# EasyEDA Pro project 3SE_24_Power_Rune.eprj, board Armour
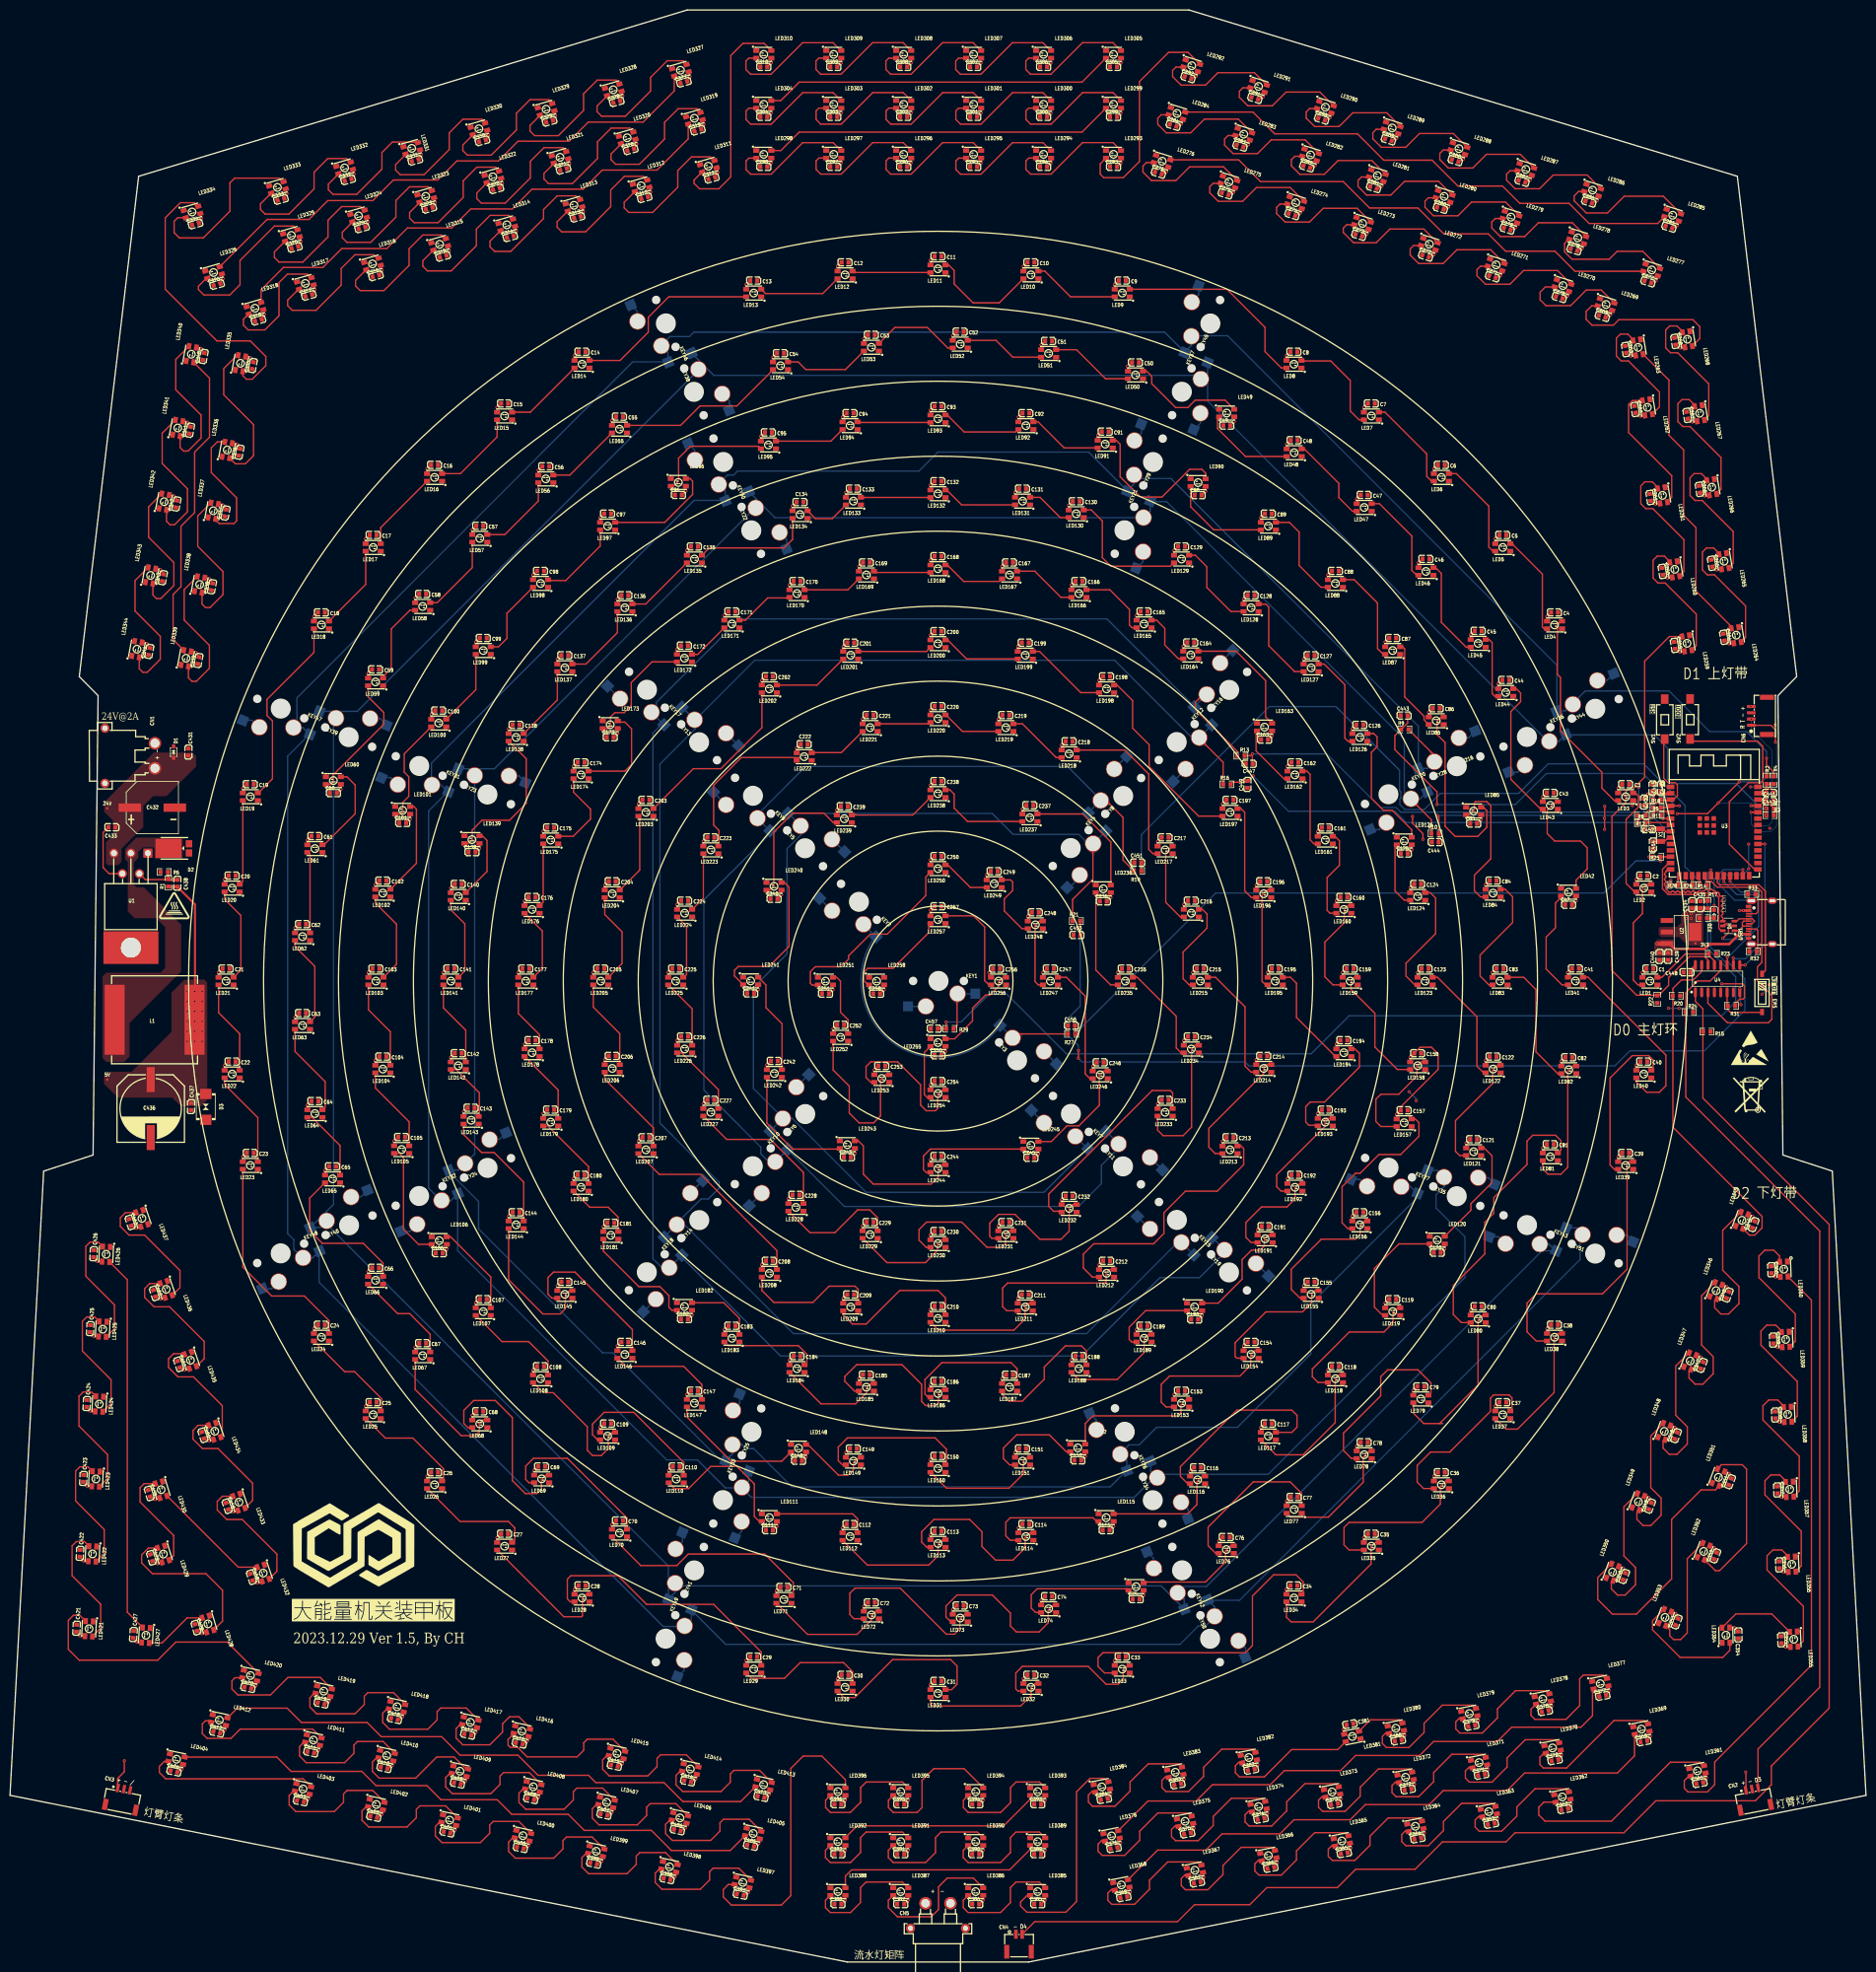
[diagram p11: board, top side]
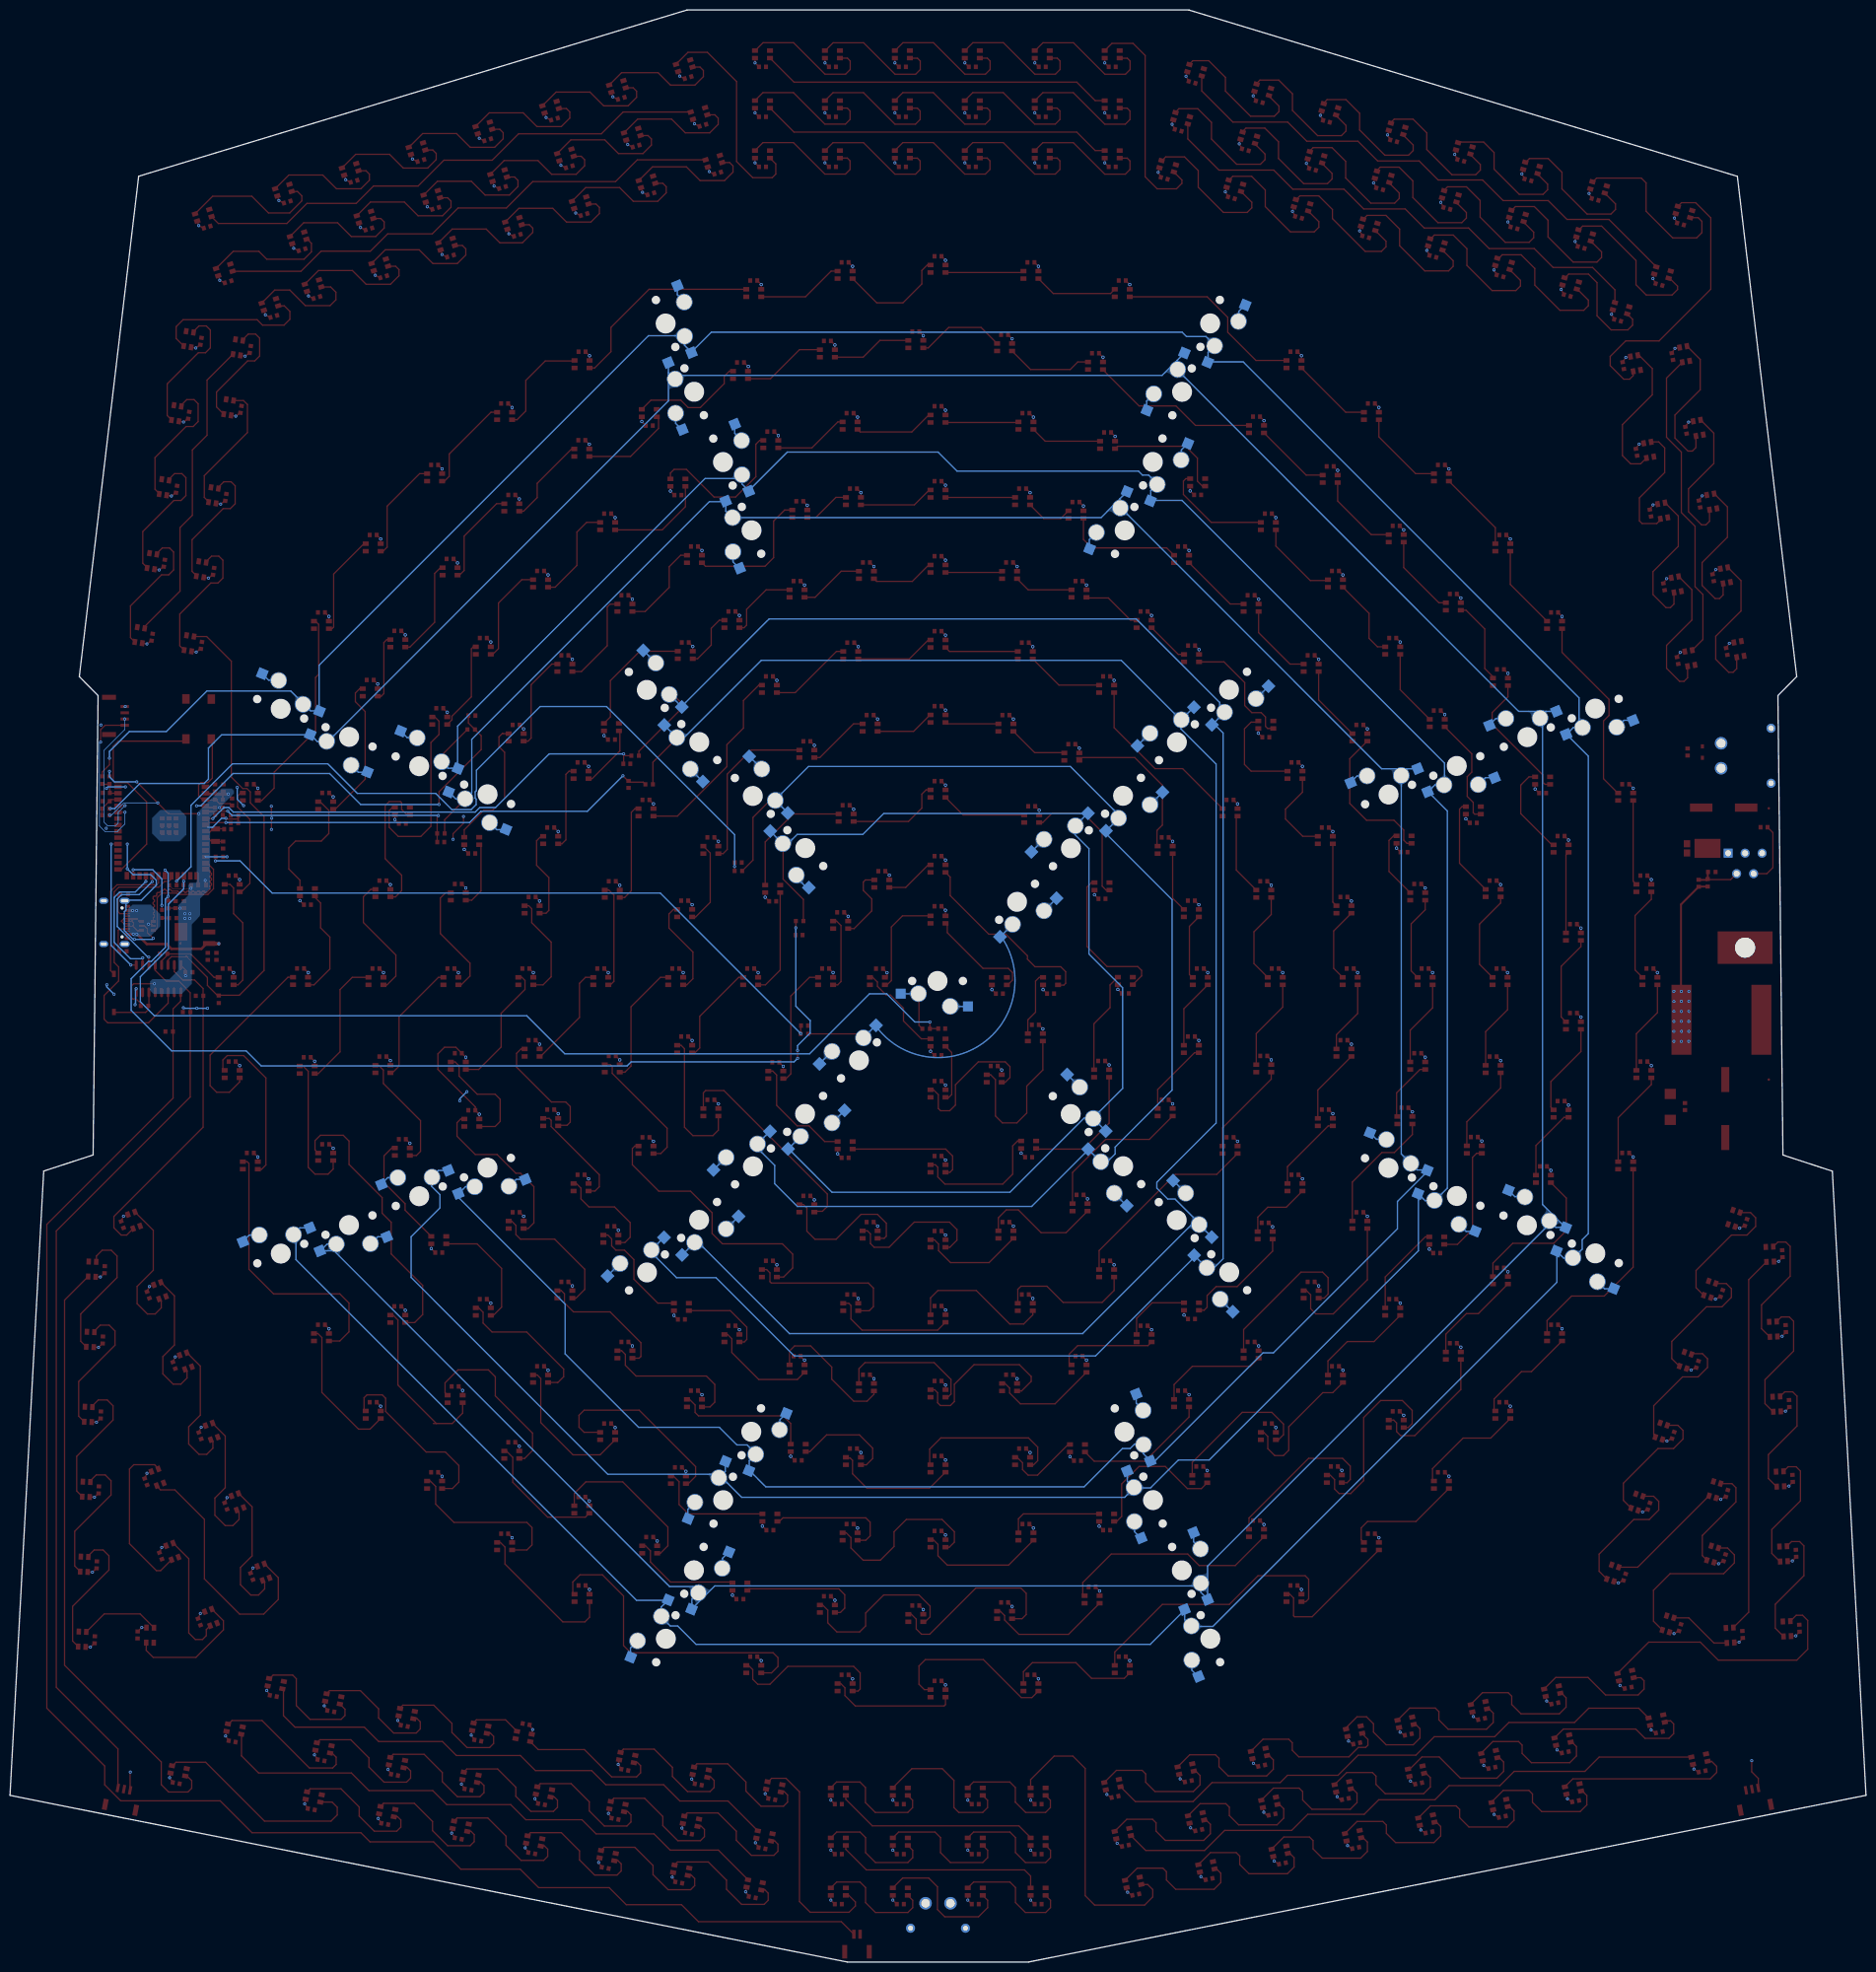
[diagram p12: board, bottom side, seen from below]

Outline 371.5 x 390.5 mm; copper layers: Top Layer, Bottom Layer. Coordinates in mm from the lower left corner of the outline.
Outline path: 0,33.35 6.74,158.22 16.63,161.45 17.63,253.35 13.87,257.14 25.75,357.23 135.52,390.5 235.98,390.5 345.75,357.23 357.63,257.15 353.87,253.35 354.87,161.44 364.76,158.22 371.5,33.34 203.91,0 167.59,0 0,33.35
Stack: Top Layer 0.035mm / Dielectric1 1.51mm FR4 er 4.5 / Bottom Layer 0.035mm

## Design rules (mm)
net DN: DP1
net DP: DP1
template: 自定义配置
spacing copperThickness1oz (default): track to track 0.152, other pairs 0.152 to 0.3
spacing copperThickness2oz: track to track 0.203, other pairs 0.152 to 0.3
track width copperThickness1oz (default): min 0.127, default 0.254, max 2.54
track width copperThickness2oz: min 0.203, default 0.254, max 2.54
differential pair differentialPair (default): width min 0.127, default 0.254, max 2.54; gap min 0.152, default 0.152
via viaSize (default): diameter min 0.5, default 0.61, max 10; hole min 0.3, default 0.305, max 6.299
net GND uses power
net +5V uses power

## Placement (name value [footprint] x y rotation side)
3V3  -  [Test-Point-0.5mm]  337.35 203.79 0 top
5V  -  [Test-Point-0.5mm]  19.46 176.53 0 top
24V  -  [Test-Point-0.5mm]  19.46 230.8 0 top
C1  -  [C0603]  328.25 198.74 0 top
C2  -  [C0603]  327.03 217.34 0 top
C3  -  [C0603]  323.39 235.62 0 top
C4  -  [C0603]  309.16 269.99 0 top
C5  -  [C0603]  298.8 285.48 0 top
C6  -  [C0603]  286.51 299.5 0 top
C7  -  [C0603]  272.5 311.79 0 top
C8  -  [C0603]  257 322.14 0 top
C9  -  [C0603]  222.63 336.38 0 top
C10  -  [C0603]  204.35 340.02 0 top
C11  -  [C0603]  185.75 341.24 0 top
C12  -  [C0603]  167.15 340.02 0 top
C13  -  [C0603]  148.87 336.38 0 top
C14  -  [C0603]  114.5 322.14 0 top
C15  -  [C0603]  99 311.79 0 top
C16  -  [C0603]  84.99 299.5 0 top
C17  -  [C0603]  72.7 285.48 0 top
C18  -  [C0603]  62.34 269.99 0 top
C19  -  [C0603]  48.1 235.62 0 top
C20  -  [C0603]  44.47 217.34 0 top
C21  -  [C0603]  43.25 198.74 0 top
C22  -  [C0603]  44.47 180.14 0 top
C23  -  [C0603]  48.1 161.85 0 top
C24  -  [C0603]  62.34 127.49 0 top
C25  -  [C0603]  72.7 111.99 0 top
C26  -  [C0603]  84.99 97.97 0 top
C27  -  [C0603]  99 85.68 0 top
C28  -  [C0603]  114.5 75.33 0 top
C29  -  [C0603]  148.87 61.09 0 top
C30  -  [C0603]  167.15 57.45 0 top
C31  -  [C0603]  185.75 56.24 0 top
C32  -  [C0603]  204.35 57.45 0 top
C33  -  [C0603]  222.63 61.09 0 top
C34  -  [C0603]  257 75.33 0 top
C35  -  [C0603]  272.5 85.68 0 top
C36  -  [C0603]  286.51 97.97 0 top
C37  -  [C0603]  298.8 111.99 0 top
C38  -  [C0603]  309.16 127.49 0 top
C39  -  [C0603]  323.39 161.85 0 top
C40  -  [C0603]  327.03 180.14 0 top
C41  -  [C0603]  313.35 198.75 0 top
C42  -  [C0603]  311.97 211.51 180 top
C43  -  [C0603]  308.31 233.88 0 top
C44  -  [C0603]  299.4 256.48 0 top
C45  -  [C0603]  293.88 266.3 0 top
C46  -  [C0603]  283.42 280.69 0 top
C47  -  [C0603]  271.06 293.49 0 top
C48  -  [C0603]  257.05 304.44 0 top
C49  -  [C0603]  243.54 307.37 180 top
C50  -  [C0603]  225.28 319.99 0 top
C51  -  [C0603]  207.89 324.3 0 top
C52  -  [C0603]  190.2 326.16 0 top
C53  -  [C0603]  172.42 325.54 0 top
C54  -  [C0603]  154.22 321.84 0 top
C55  -  [C0603]  122 309.15 0 top
C56  -  [C0603]  107.25 299.21 0 top
C57  -  [C0603]  94.03 287.3 0 top
C58  -  [C0603]  82.6 273.68 0 top
C59  -  [C0603]  73.17 258.59 0 top
C60  -  [C0603]  64.73 233.85 180 top
C61  -  [C0603]  61.04 225.24 0 top
C62  -  [C0603]  58.56 207.63 0 top
C63  -  [C0603]  58.56 189.84 0 top
C64  -  [C0603]  61.04 172.23 0 top
C65  -  [C0603]  64.57 159.17 0 top
C66  -  [C0603]  73.17 138.88 0 top
C67  -  [C0603]  82.6 123.79 0 top
C68  -  [C0603]  94.03 110.17 0 top
C69  -  [C0603]  106.41 99.13 0 top
C70  -  [C0603]  122 88.32 0 top
C71  -  [C0603]  154.9 75.02 0 top
C72  -  [C0603]  172.42 71.93 0 top
C73  -  [C0603]  190.2 71.31 0 top
C74  -  [C0603]  207.89 73.17 0 top
C75  -  [C0603]  225.4 72.6 180 top
C76  -  [C0603]  243.46 85.02 0 top
C77  -  [C0603]  257.05 93.03 0 top
C78  -  [C0603]  271.06 103.98 0 top
C79  -  [C0603]  282.4 115.14 0 top
C80  -  [C0603]  293.88 131.17 0 top
C81  -  [C0603]  308.31 163.59 0 top
C82  -  [C0603]  312.01 180.99 0 top
C83  -  [C0603]  298.25 198.74 0 top
C84  -  [C0603]  296.86 216.33 0 top
C85  -  [C0603]  292.96 227.75 180 top
C86  -  [C0603]  285.48 250.81 0 top
C87  -  [C0603]  276.76 264.86 0 top
C88  -  [C0603]  265.3 278.28 0 top
C89  -  [C0603]  251.88 289.75 0 top
C90  -  [C0603]  237.81 293.46 180 top
C91  -  [C0603]  219.22 306.16 0 top
C92  -  [C0603]  203.35 309.85 0 top
C93  -  [C0603]  185.75 311.24 0 top
C94  -  [C0603]  168.15 309.85 0 top
C95  -  [C0603]  151.81 306 0 top
C96  -  [C0603]  133.78 293.5 180 top
C97  -  [C0603]  119.62 289.75 0 top
C98  -  [C0603]  106.2 278.28 0 top
C99  -  [C0603]  94.73 264.86 0 top
C100  -  [C0603]  85.82 250.36 0 top
C101  -  [C0603]  78.6 227.89 180 top
C102  -  [C0603]  74.63 216.33 0 top
C103  -  [C0603]  73.25 198.74 0 top
C104  -  [C0603]  74.63 181.14 0 top
C105  -  [C0603]  78.4 165.04 0 top
C106  -  [C0603]  85.92 141.82 180 top
C107  -  [C0603]  94.73 132.61 0 top
C108  -  [C0603]  106.2 119.19 0 top
C109  -  [C0603]  119.62 107.72 0 top
C110  -  [C0603]  133.36 99.12 0 top
C111  -  [C0603]  152 86.4 180 top
C112  -  [C0603]  168.15 87.62 0 top
C113  -  [C0603]  185.75 86.24 0 top
C114  -  [C0603]  203.35 87.62 0 top
C115  -  [C0603]  219.4 86.4 180 top
C116  -  [C0603]  237.71 98.96 0 top
C117  -  [C0603]  251.88 107.72 0 top
C118  -  [C0603]  265.3 119.19 0 top
C119  -  [C0603]  276.76 132.61 0 top
C120  -  [C0603]  285.68 141.92 180 top
C121  -  [C0603]  292.97 164.6 0 top
C122  -  [C0603]  296.86 181.14 0 top
C123  -  [C0603]  283.25 198.74 0 top
C124  -  [C0603]  281.77 215.67 0 top
C125  -  [C0603]  279.08 221.77 180 top
C126  -  [C0603]  270.19 247.49 0 top
C127  -  [C0603]  260.44 261.41 0 top
C128  -  [C0603]  248.42 273.42 0 top
C129  -  [C0603]  234.5 283.17 0 top
C130  -  [C0603]  213.42 292.23 0 top
C131  -  [C0603]  202.68 294.75 0 top
C132  -  [C0603]  185.75 296.24 0 top
C133  -  [C0603]  168.82 294.75 0 top
C134  -  [C0603]  158.14 292.06 0 top
C135  -  [C0603]  137 283.17 0 top
C136  -  [C0603]  123.08 273.42 0 top
C137  -  [C0603]  111.06 261.41 0 top
C138  -  [C0603]  101.31 247.49 0 top
C139  -  [C0603]  92.47 222.04 180 top
C140  -  [C0603]  89.73 215.67 0 top
C141  -  [C0603]  88.25 198.74 0 top
C142  -  [C0603]  89.73 181.8 0 top
C143  -  [C0603]  92.3 170.9 0 top
C144  -  [C0603]  101.31 149.99 0 top
C145  -  [C0603]  111.06 136.06 0 top
C146  -  [C0603]  123.08 124.05 0 top
C147  -  [C0603]  137 114.3 0 top
C148  -  [C0603]  157.83 100.29 180 top
C149  -  [C0603]  168.82 102.72 0 top
C150  -  [C0603]  185.75 101.24 0 top
C151  -  [C0603]  202.68 102.72 0 top
C152  -  [C0603]  213.73 100.36 180 top
C153  -  [C0603]  234.5 114.3 0 top
C154  -  [C0603]  248.42 124.05 0 top
C155  -  [C0603]  260.44 136.06 0 top
C156  -  [C0603]  270.19 149.99 0 top
C157  -  [C0603]  279.06 170.4 0 top
C158  -  [C0603]  281.77 181.8 0 top
C159  -  [C0603]  268.25 198.74 0 top
C160  -  [C0603]  267 213.06 0 top
C161  -  [C0603]  263.27 226.95 0 top
C162  -  [C0603]  257.2 239.99 0 top
C163  -  [C0603]  251.11 244.55 180 top
C164  -  [C0603]  236.34 263.98 0 top
C165  -  [C0603]  227 270.18 0 top
C166  -  [C0603]  213.97 276.26 0 top
C167  -  [C0603]  200.08 279.98 0 top
C168  -  [C0603]  185.75 281.24 0 top
C169  -  [C0603]  171.42 279.98 0 top
C170  -  [C0603]  157.53 276.26 0 top
C171  -  [C0603]  144.5 270.18 0 top
C172  -  [C0603]  135 263.35 0 top
C173  -  [C0603]  120.14 245.03 180 top
C174  -  [C0603]  114.3 239.99 0 top
C175  -  [C0603]  108.22 226.95 0 top
C176  -  [C0603]  104.5 213.06 0 top
C177  -  [C0603]  103.25 198.74 0 top
C178  -  [C0603]  104.5 184.41 0 top
C179  -  [C0603]  108.22 170.52 0 top
C180  -  [C0603]  114.3 157.49 0 top
C181  -  [C0603]  120.27 147.88 0 top
C182  -  [C0603]  135.01 128.64 180 top
C183  -  [C0603]  144.5 127.29 0 top
C184  -  [C0603]  157.53 121.21 0 top
C185  -  [C0603]  171.42 117.49 0 top
C186  -  [C0603]  185.75 116.24 0 top
C187  -  [C0603]  200.08 117.49 0 top
C188  -  [C0603]  213.97 121.21 0 top
C189  -  [C0603]  227 127.29 0 top
C190  -  [C0603]  237.11 128.56 180 top
C191  -  [C0603]  251.23 147.19 0 top
C192  -  [C0603]  257.2 157.49 0 top
C193  -  [C0603]  263.27 170.52 0 top
C194  -  [C0603]  267 184.41 0 top
C195  -  [C0603]  253.25 198.74 0 top
C196  -  [C0603]  250.95 216.21 0 top
C197  -  [C0603]  244.21 232.49 0 top
C198  -  [C0603]  219.5 257.19 0 top
C199  -  [C0603]  203.22 263.94 0 top
C200  -  [C0603]  185.75 266.24 0 top
C201  -  [C0603]  168.28 263.94 0 top
C202  -  [C0603]  152 257.19 0 top
C203  -  [C0603]  127.29 232.49 0 top
C204  -  [C0603]  120.55 216.21 0 top
C205  -  [C0603]  118.25 198.74 0 top
C206  -  [C0603]  120.55 181.26 0 top
C207  -  [C0603]  127.29 164.99 0 top
C208  -  [C0603]  152 140.28 0 top
C209  -  [C0603]  168.28 133.54 0 top
C210  -  [C0603]  185.75 131.24 0 top
C211  -  [C0603]  203.22 133.54 0 top
C212  -  [C0603]  219.5 140.28 0 top
C213  -  [C0603]  244.21 164.99 0 top
C214  -  [C0603]  250.95 181.26 0 top
C215  -  [C0603]  238.25 198.74 0 top
C216  -  [C0603]  236.46 212.32 0 top
C217  -  [C0603]  231.22 224.99 0 top
C218  -  [C0603]  212 244.2 0 top
C219  -  [C0603]  199.34 249.45 0 top
C220  -  [C0603]  185.75 251.24 0 top
C221  -  [C0603]  172.16 249.45 0 top
C222  -  [C0603]  158.97 243.63 0 top
C223  -  [C0603]  140.28 224.99 0 top
C224  -  [C0603]  135.04 212.32 0 top
C225  -  [C0603]  133.25 198.74 0 top
C226  -  [C0603]  135.04 185.15 0 top
C227  -  [C0603]  140.28 172.49 0 top
C228  -  [C0603]  157.32 153.47 0 top
C229  -  [C0603]  172.16 148.02 0 top
C230  -  [C0603]  185.75 146.24 0 top
C231  -  [C0603]  199.34 148.02 0 top
C232  -  [C0603]  212 153.27 0 top
C233  -  [C0603]  231.22 172.49 0 top
C234  -  [C0603]  236.46 185.15 0 top
C235  -  [C0603]  223.25 198.74 0 top
C236  -  [C0603]  218.84 212.19 180 top
C237  -  [C0603]  204.14 231.42 0 top
C238  -  [C0603]  185.75 236.24 0 top
C239  -  [C0603]  167 231.21 0 top
C240  -  [C0603]  152.93 212.69 180 top
C241  -  [C0603]  148.25 193.77 180 top
C242  -  [C0603]  153 180.25 0 top
C243  -  [C0603]  167.61 161.01 180 top
C244  -  [C0603]  185.75 161.24 0 top
C245  -  [C0603]  204.34 160.89 180 top
C246  -  [C0603]  218.23 179.99 0 top
C247  -  [C0603]  208.25 198.74 0 top
C248  -  [C0603]  205.24 209.99 0 top
C249  -  [C0603]  197 218.22 0 top
C250  -  [C0603]  185.75 221.24 0 top
C251  -  [C0603]  163.22 193.73 180 top
C252  -  [C0603]  166.26 187.49 0 top
C253  -  [C0603]  174.5 179.25 0 top
C254  -  [C0603]  185.75 176.24 0 top
C255  -  [C0603]  185.75 181.39 180 top
C256  -  [C0603]  197.46 198.72 0 top
C257  -  [C0603]  185.76 211.21 0 top
C258  -  [C0603]  173.46 193.72 180 top
C259  -  [C0603]  333.19 263.4 99.4 top
C260  -  [C0603]  330.75 278.2 99.4 top
C261  -  [C0603]  328.3 293 99.4 top
C262  -  [C0603]  325.27 310.61 99.4 top
C263  -  [C0603]  323.41 322.6 99.4 top
C264  -  [C0603]  343.06 265.03 99.4 top
C265  -  [C0603]  340.62 279.83 99.4 top
C266  -  [C0603]  338.17 294.63 99.4 top
C267  -  [C0603]  335.73 309.43 99.4 top
C268  -  [C0603]  333.28 324.23 99.4 top
C269  -  [C0603]  318.71 329.21 162.8 top
C270  -  [C0603]  310.09 332.98 162.8 top
C271  -  [C0603]  296.72 337.13 162.8 top
C272  -  [C0603]  283.34 341.28 162.8 top
C273  -  [C0603]  269.97 345.43 162.8 top
C274  -  [C0603]  256.6 349.58 162.8 top
C275  -  [C0603]  243.23 353.72 162.8 top
C276  -  [C0603]  229.86 357.87 162.8 top
C277  -  [C0603]  327.85 336.12 162.8 top
C278  -  [C0603]  313.05 342.54 162.8 top
C279  -  [C0603]  299.68 346.68 162.8 top
C280  -  [C0603]  286.31 350.83 162.8 top
C281  -  [C0603]  272.94 354.98 162.8 top
C282  -  [C0603]  259.56 359.13 162.8 top
C283  -  [C0603]  246.19 363.28 162.8 top
C284  -  [C0603]  232.82 367.42 162.8 top
C285  -  [C0603]  332.05 347.06 162.8 top
C286  -  [C0603]  316.01 352.09 162.8 top
C287  -  [C0603]  302.64 356.23 162.8 top
C288  -  [C0603]  289.27 360.38 162.8 top
C289  -  [C0603]  275.9 364.53 162.8 top
C290  -  [C0603]  262.53 368.68 162.8 top
C291  -  [C0603]  249.16 372.83 162.8 top
C292  -  [C0603]  235.79 376.97 162.8 top
C293  -  [C0603]  220.88 359.13 180 top
C294  -  [C0603]  206.88 359.13 180 top
C295  -  [C0603]  192.88 359.13 180 top
C296  -  [C0603]  178.88 359.13 180 top
C297  -  [C0603]  164.88 359.13 180 top
C298  -  [C0603]  150.88 359.13 180 top
C299  -  [C0603]  220.88 369.13 180 top
C300  -  [C0603]  206.88 369.13 180 top
C301  -  [C0603]  192.88 369.13 180 top
C302  -  [C0603]  178.88 369.13 180 top
C303  -  [C0603]  164.88 369.13 180 top
C304  -  [C0603]  150.88 369.13 180 top
C305  -  [C0603]  220.88 379.13 180 top
C306  -  [C0603]  206.88 379.13 180 top
C307  -  [C0603]  192.88 379.13 180 top
C308  -  [C0603]  178.88 379.13 180 top
C309  -  [C0603]  164.88 379.13 180 top
C310  -  [C0603]  150.88 379.13 180 top
C311  -  [C0603]  140.47 356.85 196.2 top
C312  -  [C0603]  127.03 352.94 196.2 top
C313  -  [C0603]  113.58 349.03 196.2 top
C314  -  [C0603]  100.14 345.12 196.2 top
C315  -  [C0603]  86.7 341.22 196.2 top
C316  -  [C0603]  73.25 337.31 196.2 top
C317  -  [C0603]  59.81 333.4 196.2 top
C318  -  [C0603]  49.73 328.44 196.2 top
C319  -  [C0603]  137.68 366.45 196.2 top
C320  -  [C0603]  124.24 362.54 196.2 top
C321  -  [C0603]  110.79 358.63 196.2 top
C322  -  [C0603]  97.35 354.73 196.2 top
C323  -  [C0603]  83.91 350.82 196.2 top
C324  -  [C0603]  70.46 346.91 196.2 top
C325  -  [C0603]  57.02 343.01 196.2 top
C326  -  [C0603]  41.44 335.58 196.2 top
C327  -  [C0603]  134.89 376.05 196.2 top
C328  -  [C0603]  121.45 372.14 196.2 top
C329  -  [C0603]  108 368.24 196.2 top
C330  -  [C0603]  94.56 364.33 196.2 top
C331  -  [C0603]  81.11 360.42 196.2 top
C332  -  [C0603]  67.67 356.52 196.2 top
C333  -  [C0603]  54.23 352.61 196.2 top
C334  -  [C0603]  37.13 347.69 196.2 top
C335  -  [C0603]  48.59 319.37 259.5 top
C336  -  [C0603]  45.94 302.03 259.5 top
C337  -  [C0603]  43.15 289.87 259.5 top
C338  -  [C0603]  40.43 275.12 259.5 top
C339  -  [C0603]  37.71 260.37 259.5 top
C340  -  [C0603]  38.76 321.19 259.5 top
C341  -  [C0603]  36.04 306.43 259.5 top
C342  -  [C0603]  33.32 291.68 259.5 top
C343  -  [C0603]  30.6 276.93 259.5 top
C344  -  [C0603]  27.87 262.18 259.5 top
C345  -  [C0603]  349.02 147.52 249.8 top
C346  -  [C0603]  343.84 133.44 249.8 top
C347  -  [C0603]  338.66 119.37 249.8 top
C348  -  [C0603]  333.47 105.29 249.8 top
C349  -  [C0603]  328.29 91.21 249.8 top
C350  -  [C0603]  323.11 77.14 249.8 top
C351  -  [C0603]  344.3 96.08 249.1 top
C352  -  [C0603]  341.35 81.24 249.1 top
C353  -  [C0603]  333.61 68.05 249.1 top
C354  -  [C0603]  345.96 65.43 271 top
C355  -  [C0603]  354.55 64.46 92.5 top
C356  -  [C0603]  354.14 79.46 92.5 top
C357  -  [C0603]  353.74 94.45 92.5 top
C358  -  [C0603]  353.33 109.44 92.5 top
C359  -  [C0603]  352.92 124.43 92.5 top
C360  -  [C0603]  352.55 138.5 92.2 top
C361  -  [C0603]  338.24 35.79 191.3 top
C362  -  [C0603]  311.2 30.56 191.3 top
C363  -  [C0603]  296.49 27.63 191.3 top
C364  -  [C0603]  281.78 24.7 191.3 top
C365  -  [C0603]  267.07 21.76 191.3 top
C366  -  [C0603]  252.36 18.83 191.3 top
C367  -  [C0603]  237.65 15.9 191.3 top
C368  -  [C0603]  222.94 12.97 191.3 top
C369  -  [C0603]  327.04 44.14 191.3 top
C370  -  [C0603]  309.25 40.37 191.3 top
C371  -  [C0603]  294.53 37.44 191.3 top
C372  -  [C0603]  279.82 34.5 191.3 top
C373  -  [C0603]  265.11 31.57 191.3 top
C374  -  [C0603]  250.4 28.64 191.3 top
C375  -  [C0603]  235.69 25.71 191.3 top
C376  -  [C0603]  220.98 22.77 191.3 top
C377  -  [C0603]  318.8 53.23 191.3 top
C378  -  [C0603]  307.29 50.18 191.3 top
C379  -  [C0603]  292.58 47.24 191.3 top
C380  -  [C0603]  277.87 44.31 191.3 top
C381  -  [C0603]  268.2 47.58 11.3 top
C382  -  [C0603]  248.45 38.45 191.3 top
C383  -  [C0603]  233.74 35.51 191.3 top
C384  -  [C0603]  219.03 32.58 191.3 top
C385  -  [C0603]  205.7 11.58 180 top
C386  -  [C0603]  193.29 11.58 180 top
C387  -  [C0603]  178.29 11.58 180 top
C388  -  [C0603]  165.71 11.58 180 top
C389  -  [C0603]  205.7 21.58 180 top
C390  -  [C0603]  193.29 21.58 180 top
C391  -  [C0603]  178.29 21.58 180 top
C392  -  [C0603]  165.71 21.58 180 top
C393  -  [C0603]  205.7 31.58 180 top
C394  -  [C0603]  193.29 31.58 180 top
C395  -  [C0603]  178.29 31.58 180 top
C396  -  [C0603]  165.71 31.58 180 top
C397  -  [C0603]  146.17 13.48 168 top
C398  -  [C0603]  131.5 16.6 168 top
C399  -  [C0603]  116.82 19.71 168 top
C400  -  [C0603]  102.15 22.83 168 top
C401  -  [C0603]  87.48 25.94 168 top
C402  -  [C0603]  72.8 29.06 168 top
C403  -  [C0603]  58.13 32.17 168 top
C404  -  [C0603]  32.81 38.13 168 top
C405  -  [C0603]  148.25 23.26 168 top
C406  -  [C0603]  133.57 26.38 168 top
C407  -  [C0603]  118.9 29.49 168 top
C408  -  [C0603]  104.23 32.61 168 top
C409  -  [C0603]  89.55 35.72 168 top
C410  -  [C0603]  74.88 38.84 168 top
C411  -  [C0603]  60.21 41.96 168 top
C412  -  [C0603]  41.38 45.95 168 top
C413  -  [C0603]  150.32 33.04 168 top
C414  -  [C0603]  135.65 36.16 168 top
C415  -  [C0603]  120.98 39.27 168 top
C416  -  [C0603]  101.94 43.73 168 top
C417  -  [C0603]  91.63 45.51 168 top
C418  -  [C0603]  76.96 48.62 168 top
C419  -  [C0603]  62.29 51.74 168 top
C420  -  [C0603]  47.61 54.85 168 top
C421  -  [C0603]  13.32 66.78 87.4 top
C422  -  [C0603]  14.01 81.76 87.4 top
C423  -  [C0603]  14.69 96.75 87.4 top
C424  -  [C0603]  15.38 111.73 87.4 top
C425  -  [C0603]  16.06 126.71 87.4 top
C426  -  [C0603]  16.75 141.7 87.4 top
C427  -  [C0603]  24.71 65.52 86.5 top
C428  -  [C0603]  37.23 66.9 107.1 top
C429  -  [C0603]  28.31 80.87 107.1 top
C430  -  [C0603]  27.86 93.75 107.1 top
C431  1uF  [C0603]  35.71 242.06 270 top
C432  470uF  [CAP-SMD_BD10.0-L10.3-W10.3-LS11.0-FD]  28.49 230.94 0 top
C433  1uF  [C0603]  20.41 227.02 0 top
C434  10uF  [C0603]  336.7 211.54 90 top
C435  100nF  [C0603]  338.37 211.53 270 top
C436  1000uF  [CAP-SMD_BD12.5-L13.0-W13.0-RD]  28.17 170.74 90 top
C437  1uF  [C0603]  36.24 171.14 90 top